# EasyEDA Pro project 嵌入式.eprj, board 驱动底板原理图
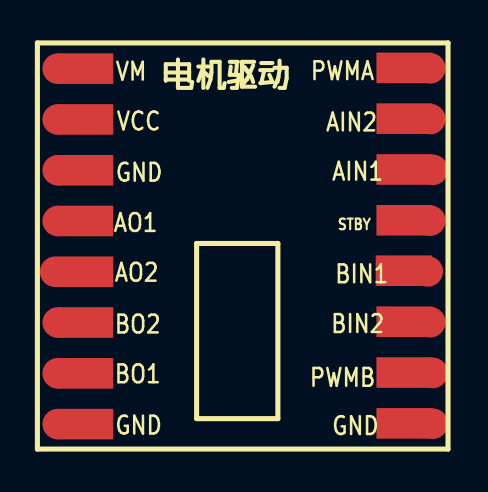
[diagram p10: board, top side]
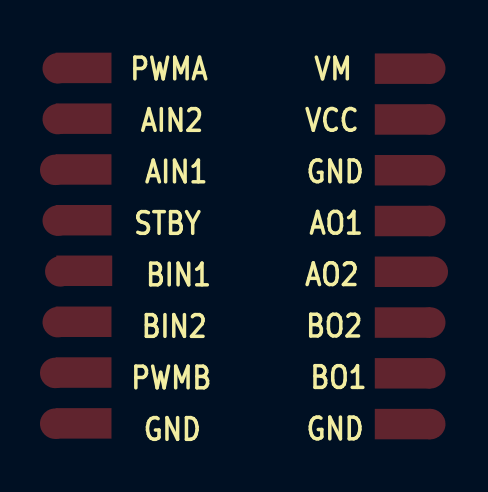
[diagram p11: board, bottom side, seen from below]

No outline. copper layers: Top Layer, Bottom Layer. Coordinates in mm from the lowest, leftmost part position.
Stack: Top Layer 0.035mm / Dielectric1 1.51mm FR4 er 4.5 / Bottom Layer 0.035mm

## Design rules (mm)
template: JLCPCB Capability(Two Layers Board)
spacing copperThickness1oz (default): track to track 0.102, other pairs 0.152 to 0.3
spacing copperThickness2oz: track to track 0.203, other pairs 0.152 to 0.3
track width copperThickness1oz (default): min 0.127, default 0.254, max 2.54
track width copperThickness2oz: min 0.203, default 0.254, max 2.54
differential pair differentialPair (default): width min 0.127, default 0.254, max 2.54; gap min 0.152, default 0.152
via viaSize (default): diameter min 0.5, default 0.61, max 10; hole min 0.3, default 0.305, max 6.3

## Placement (name value [footprint] x y rotation side)
NOREF  -  [Pad_e121]  17.43 7.67 180 top
NOREF#2  -  [Pad_e126]  17.47 12.74 180 top
NOREF#3  -  [Pad_e268]  18.88 0.02 0 top
NOREF#4  -  [Pad_e260]  0.13 0 0 top
NOREF#5  -  [Pad_e128]  17.47 5.12 180 top
NOREF#6  -  [Pad_e2]  1.5 5.08 0 top
NOREF#7  -  [Pad_e265]  18.63 7.64 0 top
NOREF#8  -  [Pad_e267]  18.88 2.56 0 top
NOREF#9  -  [Pad_e258]  0.13 5.08 0 top
NOREF#10  -  [Pad_e256]  0.13 10.16 0 top
NOREF#11  -  [Pad_e0]  1.5 15.24 0 top
NOREF#12  -  [Pad_e123]  17.47 10.2 180 top
NOREF#13  -  [Pad_e1]  1.5 10.16 0 top
NOREF#14  -  [Pad_e7]  1.5 0 0 top
NOREF#15  -  [Pad_e255]  0.13 12.7 0 top
NOREF#16  -  [Pad_e6]  1.5 2.54 0 top
NOREF#17  -  [Pad_e261]  18.75 17.8 0 top
NOREF#18  -  [Pad_e5]  1.5 7.62 0 top
NOREF#19  -  [Pad_e262]  18.75 15.26 0 top
NOREF#20  -  [Pad_e263]  18.88 12.72 0 top
NOREF#21  -  [Pad_e266]  18.75 5.1 0 top
NOREF#22  -  [Pad_e259]  0.13 2.54 0 top
NOREF#23  -  [Pad_e124]  17.47 17.82 180 top
NOREF#24  -  [Pad_e3]  1.5 17.78 0 top
NOREF#25  -  [Pad_e257]  0 7.62 0 top
NOREF#26  -  [Pad_e129]  17.47 2.58 180 top
NOREF#27  -  [Pad_e125]  17.47 15.28 180 top
NOREF#28  -  [Pad_e254]  0.13 15.24 0 top
NOREF#29  -  [Pad_e250]  0.13 17.78 0 top
NOREF#30  -  [Pad_e4]  1.5 12.7 0 top
NOREF#31  -  [Pad_e264]  18.75 10.18 0 top
NOREF#32  -  [Pad_e127]  17.47 0.04 180 top

## Footprints (pads in the part's own frame, mm; a bottom-side part is the same pattern mirrored in y, then rotated)
Pad_e0
  rect 2.794x1.524 smd: 25(0,0)
Pad_e1
  rect 2.794x1.524 smd: 25(0,0)
Pad_e2
  rect 2.794x1.524 smd: 25(0,0)
Pad_e3
  rect 2.794x1.524 smd: 25(0,0)
Pad_e4
  rect 2.794x1.524 smd: 25(0,0)
Pad_e5
  rect 2.794x1.524 smd: 25(0,0)
Pad_e6
  rect 2.794x1.524 smd: 25(0,0)
Pad_e7
  rect 2.794x1.524 smd: 25(0,0)
Pad_e121
  rect 2.794x1.524 smd: 25(0,0)
Pad_e123
  rect 2.794x1.524 smd: 25(0,0)
Pad_e124
  rect 2.794x1.524 smd: 25(0,0)
Pad_e125
  rect 2.794x1.524 smd: 25(0,0)
Pad_e126
  rect 2.794x1.524 smd: 25(0,0)
Pad_e127
  rect 2.794x1.524 smd: 25(0,0)
Pad_e128
  rect 2.794x1.524 smd: 25(0,0)
Pad_e129
  rect 2.794x1.524 smd: 25(0,0)
Pad_e250
  round 1.524 smd: 1(0,0)
Pad_e254
  round 1.524 smd: 1(0,0)
Pad_e255
  round 1.524 smd: 1(0,0)
Pad_e256
  round 1.524 smd: 1(0,0)
Pad_e257
  round 1.524 smd: 1(0,0)
Pad_e258
  round 1.524 smd: 1(0,0)
Pad_e259
  round 1.524 smd: 1(0,0)
Pad_e260
  round 1.524 smd: 1(0,0)
Pad_e261
  round 1.524 smd: 1(0,0)
Pad_e262
  round 1.524 smd: 1(0,0)
Pad_e263
  round 1.524 smd: 1(0,0)
Pad_e264
  round 1.524 smd: 1(0,0)
Pad_e265
  round 1.524 smd: 1(0,0)
Pad_e266
  round 1.524 smd: 1(0,0)
Pad_e267
  round 1.524 smd: 1(0,0)
Pad_e268
  round 1.524 smd: 1(0,0)

## Nets
12V: NOREF#24.25 NOREF#29.1
GND: NOREF#3.1 NOREF#4.1 NOREF#14.25 NOREF#15.1 NOREF#30.25 NOREF#32.25
VCC: NOREF#11.25 NOREF#28.1
AIN1: NOREF#2.25 NOREF#20.1
AIN2: NOREF#19.1 NOREF#27.25
AO1: NOREF#10.1 NOREF#13.25
AO2: NOREF#18.25 NOREF#25.1
BIN1: NOREF.25 NOREF#7.1
BIN2: NOREF#5.25 NOREF#21.1
BO1: NOREF#16.25 NOREF#22.1
BO2: NOREF#6.25 NOREF#9.1
PWMA: NOREF#17.1 NOREF#23.25
PWMB: NOREF#8.1 NOREF#26.25
STBY: NOREF#12.25 NOREF#31.1

Small or netless copper shapes (teardrops, artwork), in the pictures only: 1 on Top Layer

## Text on the board
Bottom Silkscreen Layer: VM | BO1 | AO1 | GND | BO2 | VCC | AO2 | BIN1 | AIN1 | BIN2 | AIN2 | STBY | PWMB | PWMA
Top Silkscreen Layer: STBY | AO1 | AO2 | BO2 | BO1 | GND | VM | VCC | PWMB | PWMA | AIN2 | BIN2 | AIN1 | BIN1 | 电机驱动
